# EAGLE schematic Resistor_Resistor (EAGLE 8.3.0), part 2 of 43
## Parts (continued)
R1479  10K  RESISTOR_0201  [0201]
R1480  10K  RESISTOR_0201  [0201]
R1481  10K  RESISTOR_0201  [0201]
R1482  10K  RESISTOR_0201  [0201]
R1483  10K  RESISTOR_0201  [0201]
R1484  10K  RESISTOR_0201  [0201]
R1485  10K  RESISTOR_0201  [0201]
R1486  10K  RESISTOR_0201  [0201]
R1487  10K  RESISTOR_0201  [0201]
R1488  10K  RESISTOR_0201  [0201]
R1489  10K  RESISTOR_0201  [0201]
R1490  10K  RESISTOR_0201  [0201]
R1491  10K  RESISTOR_0201  [0201]
R1492  10K  RESISTOR_0201  [0201]
R1493  10K  RESISTOR_0201  [0201]
R1494  10K  RESISTOR_0201  [0201]
R1495  10K  RESISTOR_0201  [0201]
R1496  10K  RESISTOR_0201  [0201]
R1497  10K  RESISTOR_0201  [0201]
R1498  10K  RESISTOR_0201  [0201]
R1499  10K  RESISTOR_0201  [0201]
R1500  10K  RESISTOR_0201  [0201]
R1501  10K  RESISTOR_0201  [0201]
R1502  10K  RESISTOR_0201  [0201]
R1503  10K  RESISTOR_0201  [0201]
R1504  10K  RESISTOR_0201  [0201]
R1505  10K  RESISTOR_0201  [0201]
R1506  10K  RESISTOR_0201  [0201]
R1507  10K  RESISTOR_0201  [0201]
R1508  10K  RESISTOR_0201  [0201]
R1509  10K  RESISTOR_0201  [0201]
R1510  10K  RESISTOR_0201  [0201]
R1511  10K  RESISTOR_0201  [0201]
R1512  10K  RESISTOR_0201  [0201]
R1513  10K  RESISTOR_0201  [0201]
R1514  10K  RESISTOR_0201  [0201]
R1515  10K  RESISTOR_0201  [0201]
R1516  10K  RESISTOR_0201  [0201]
R1517  10K  RESISTOR_0201  [0201]
R1518  10K  RESISTOR_0201  [0201]
R1519  10K  RESISTOR_0201  [0201]
R1520  10K  RESISTOR_0201  [0201]
R1521  10K  RESISTOR_0201  [0201]
R1522  10K  RESISTOR_0201  [0201]
R1523  10K  RESISTOR_0201  [0201]
R1524  10K  RESISTOR_0201  [0201]
R1525  10K  RESISTOR_0201  [0201]
R1526  10K  RESISTOR_0201  [0201]
R1527  10K  RESISTOR_0201  [0201]
R1528  10K  RESISTOR_0201  [0201]
R1529  10K  RESISTOR_0201  [0201]
R1530  10K  RESISTOR_0201  [0201]
R1531  10K  RESISTOR_0201  [0201]
R1532  10K  RESISTOR_0201  [0201]
R1533  10K  RESISTOR_0201  [0201]
R1534  10K  RESISTOR_0201  [0201]
R1535  10K  RESISTOR_0201  [0201]
R1536  10K  RESISTOR_0201  [0201]
R1537  10K  RESISTOR_0201  [0201]
R1538  10K  RESISTOR_0201  [0201]
R1539  10K  RESISTOR_0201  [0201]
R1540  10K  RESISTOR_0201  [0201]
R1541  10K  RESISTOR_0201  [0201]
R1542  10K  RESISTOR_0201  [0201]
R1543  10K  RESISTOR_0201  [0201]
R1544  10K  RESISTOR_0201  [0201]
R1545  10K  RESISTOR_0201  [0201]
R1546  10K  RESISTOR_0201  [0201]
R1547  10K  RESISTOR_0201  [0201]
R1548  10K  RESISTOR_0201  [0201]
R1549  10K  RESISTOR_0201  [0201]
R1550  10K  RESISTOR_0201  [0201]
R1551  10K  RESISTOR_0201  [0201]
R1552  10K  RESISTOR_0201  [0201]
R1553  10K  RESISTOR_0201  [0201]
R1554  10K  RESISTOR_0201  [0201]
R1555  10K  RESISTOR_0201  [0201]
R1556  10K  RESISTOR_0201  [0201]
R1557  10K  RESISTOR_0201  [0201]
R1558  10K  RESISTOR_0201  [0201]
R1559  10K  RESISTOR_0201  [0201]
R1560  10K  RESISTOR_0201  [0201]
R1561  10K  RESISTOR_0201  [0201]
R1562  10K  RESISTOR_0201  [0201]
R1563  10K  RESISTOR_0201  [0201]
R1564  10K  RESISTOR_0201  [0201]
R1565  10K  RESISTOR_0201  [0201]
R1566  10K  RESISTOR_0201  [0201]
R1567  10K  RESISTOR_0201  [0201]
R1568  10K  RESISTOR_0201  [0201]
R1569  10K  RESISTOR_0201  [0201]
R1570  10K  RESISTOR_0201  [0201]
R1571  10K  RESISTOR_0201  [0201]
R1572  10K  RESISTOR_0201  [0201]
R1573  10K  RESISTOR_0201  [0201]
R1574  10K  RESISTOR_0201  [0201]
R1575  10K  RESISTOR_0201  [0201]
R1576  10K  RESISTOR_0201  [0201]
R1577  10K  RESISTOR_0201  [0201]
R1578  10K  RESISTOR_0201  [0201]
R1579  10K  RESISTOR_0201  [0201]
R1580  10K  RESISTOR_0201  [0201]
R1581  10K  RESISTOR_0201  [0201]
R1582  10K  RESISTOR_0201  [0201]
R1583  10K  RESISTOR_0201  [0201]
R1584  10K  RESISTOR_0201  [0201]
R1585  10K  RESISTOR_0201  [0201]
R1586  10K  RESISTOR_0201  [0201]
R1587  10K  RESISTOR_0201  [0201]
R1588  10K  RESISTOR_0201  [0201]
R1589  10K  RESISTOR_0201  [0201]
R1590  10K  RESISTOR_0201  [0201]
R1591  10K  RESISTOR_0201  [0201]
R1592  10K  RESISTOR_0201  [0201]
R1593  10K  RESISTOR_0201  [0201]
R1594  10K  RESISTOR_0201  [0201]
R1595  10K  RESISTOR_0201  [0201]
R1596  10K  RESISTOR_0201  [0201]
R1597  10K  RESISTOR_0201  [0201]
R1598  10K  RESISTOR_0201  [0201]
R1599  10K  RESISTOR_0201  [0201]
R1600  10K  RESISTOR_0201  [0201]
R1601  10K  RESISTOR_0201  [0201]
R1602  10K  RESISTOR_0201  [0201]
R1603  10K  RESISTOR_0201  [0201]
R1604  10K  RESISTOR_0201  [0201]
R1605  10K  RESISTOR_0201  [0201]
R1606  10K  RESISTOR_0201  [0201]
R1607  10K  RESISTOR_0201  [0201]
R1608  10K  RESISTOR_0201  [0201]
R1609  10K  RESISTOR_0201  [0201]
R1610  10K  RESISTOR_0201  [0201]
R1611  10K  RESISTOR_0201  [0201]
R1612  10K  RESISTOR_0201  [0201]
R1613  10K  RESISTOR_0201  [0201]
R1614  10K  RESISTOR_0201  [0201]
R1615  10K  RESISTOR_0201  [0201]
R1616  10K  RESISTOR_0201  [0201]
R1617  10K  RESISTOR_0201  [0201]
R1618  10K  RESISTOR_0201  [0201]
R1619  10K  RESISTOR_0201  [0201]
R1620  10K  RESISTOR_0201  [0201]
R1621  10K  RESISTOR_0201  [0201]
R1622  10K  RESISTOR_0201  [0201]
R1623  10K  RESISTOR_0201  [0201]
R1624  10K  RESISTOR_0201  [0201]
R1625  10K  RESISTOR_0201  [0201]
R1626  10K  RESISTOR_0201  [0201]
R1627  10K  RESISTOR_0201  [0201]
R1628  10K  RESISTOR_0201  [0201]
R1629  10K  RESISTOR_0201  [0201]
R1630  10K  RESISTOR_0201  [0201]
R1631  10K  RESISTOR_0201  [0201]
R1632  10K  RESISTOR_0201  [0201]
R1633  10K  RESISTOR_0201  [0201]
R1634  10K  RESISTOR_0201  [0201]
R1635  10K  RESISTOR_0201  [0201]
R1636  10K  RESISTOR_0201  [0201]
R1637  10K  RESISTOR_0201  [0201]
R1638  10K  RESISTOR_0201  [0201]
R1639  10K  RESISTOR_0201  [0201]
R1640  10K  RESISTOR_0201  [0201]
R1641  10K  RESISTOR_0201  [0201]
R1642  10K  RESISTOR_0201  [0201]
R1643  10K  RESISTOR_0201  [0201]
R1644  10K  RESISTOR_0201  [0201]
R1645  10K  RESISTOR_0201  [0201]
R1646  10K  RESISTOR_0201  [0201]
R1647  10K  RESISTOR_0201  [0201]
R1648  10K  RESISTOR_0201  [0201]
R1649  10K  RESISTOR_0201  [0201]
R1650  10K  RESISTOR_0201  [0201]
R1651  10K  RESISTOR_0201  [0201]
R1652  10K  RESISTOR_0201  [0201]
R1653  10K  RESISTOR_0201  [0201]
R1654  10K  RESISTOR_0201  [0201]
R1655  10K  RESISTOR_0201  [0201]
R1656  10K  RESISTOR_0201  [0201]
R1657  10K  RESISTOR_0201  [0201]
R1658  10K  RESISTOR_0201  [0201]
R1659  10K  RESISTOR_0201  [0201]
R1660  10K  RESISTOR_0201  [0201]
R1661  10K  RESISTOR_0201  [0201]
R1662  10K  RESISTOR_0201  [0201]
R1663  10K  RESISTOR_0201  [0201]
R1664  10K  RESISTOR_0201  [0201]
R1665  10K  RESISTOR_0201  [0201]
R1666  10K  RESISTOR_0201  [0201]
R1667  10K  RESISTOR_0201  [0201]
R1668  10K  RESISTOR_0201  [0201]
R1669  10K  RESISTOR_0201  [0201]
R1670  10K  RESISTOR_0201  [0201]
R1671  10K  RESISTOR_0201  [0201]
R1672  10K  RESISTOR_0201  [0201]
R1673  10K  RESISTOR_0201  [0201]
R1674  10K  RESISTOR_0201  [0201]
R1675  10K  RESISTOR_0201  [0201]
R1676  10K  RESISTOR_0201  [0201]
R1677  10K  RESISTOR_0201  [0201]
R1678  10K  RESISTOR_0201  [0201]
R1679  10K  RESISTOR_0201  [0201]
R1680  10K  RESISTOR_0201  [0201]
R1681  10K  RESISTOR_0201  [0201]
R1682  10K  RESISTOR_0201  [0201]
R1683  10K  RESISTOR_0201  [0201]
R1684  10K  RESISTOR_0201  [0201]
R1685  10K  RESISTOR_0201  [0201]
R1686  10K  RESISTOR_0201  [0201]
R1687  10K  RESISTOR_0201  [0201]
R1688  10K  RESISTOR_0201  [0201]
R1689  10K  RESISTOR_0201  [0201]
R1690  10K  RESISTOR_0201  [0201]
R1691  10K  RESISTOR_0201  [0201]
R1692  10K  RESISTOR_0201  [0201]
R1693  10K  RESISTOR_0201  [0201]
R1694  10K  RESISTOR_0201  [0201]
R1695  10K  RESISTOR_0201  [0201]
R1696  10K  RESISTOR_0201  [0201]
R1697  10K  RESISTOR_0201  [0201]
R1698  10K  RESISTOR_0201  [0201]
R1699  10K  RESISTOR_0201  [0201]
R1700  10K  RESISTOR_0201  [0201]
R1701  10K  RESISTOR_0201  [0201]
R1702  10K  RESISTOR_0201  [0201]
R1703  10K  RESISTOR_0201  [0201]
R1704  10K  RESISTOR_0201  [0201]
R1705  10K  RESISTOR_0201  [0201]
R1706  10K  RESISTOR_0201  [0201]
R1707  10K  RESISTOR_0201  [0201]
R1708  10K  RESISTOR_0201  [0201]
R1709  10K  RESISTOR_0201  [0201]
R1710  10K  RESISTOR_0201  [0201]
R1711  10K  RESISTOR_0201  [0201]
R1712  10K  RESISTOR_0201  [0201]
R1713  10K  RESISTOR_0201  [0201]
R1714  10K  RESISTOR_0201  [0201]
R1715  10K  RESISTOR_0201  [0201]
R1716  10K  RESISTOR_0201  [0201]
R1717  10K  RESISTOR_0201  [0201]
R1718  10K  RESISTOR_0201  [0201]
R1719  10K  RESISTOR_0201  [0201]
R1720  10K  RESISTOR_0201  [0201]
R1721  10K  RESISTOR_0201  [0201]
R1722  10K  RESISTOR_0201  [0201]
R1723  10K  RESISTOR_0201  [0201]
R1724  10K  RESISTOR_0201  [0201]
R1725  10K  RESISTOR_0201  [0201]
R1726  10K  RESISTOR_0201  [0201]
R1727  10K  RESISTOR_0201  [0201]
R1728  10K  RESISTOR_0201  [0201]
R1729  10K  RESISTOR_0201  [0201]
R1730  10K  RESISTOR_0201  [0201]
R1731  10K  RESISTOR_0201  [0201]
R1732  10K  RESISTOR_0201  [0201]
R1733  10K  RESISTOR_0201  [0201]
R1734  10K  RESISTOR_0201  [0201]
R1735  10K  RESISTOR_0201  [0201]
R1736  10K  RESISTOR_0201  [0201]
R1737  10K  RESISTOR_0201  [0201]
R1738  10K  RESISTOR_0201  [0201]
R1739  10K  RESISTOR_0201  [0201]
R1740  10K  RESISTOR_0201  [0201]
R1741  10K  RESISTOR_0201  [0201]
R1742  10K  RESISTOR_0201  [0201]
R1743  10K  RESISTOR_0201  [0201]
R1744  10K  RESISTOR_0201  [0201]
R1745  10K  RESISTOR_0201  [0201]
R1746  10K  RESISTOR_0201  [0201]
R1747  10K  RESISTOR_0201  [0201]
R1748  10K  RESISTOR_0201  [0201]
R1749  10K  RESISTOR_0201  [0201]
R1750  10K  RESISTOR_0201  [0201]
R1751  10K  RESISTOR_0201  [0201]
R1752  10K  RESISTOR_0201  [0201]
R1753  10K  RESISTOR_0201  [0201]
R1754  10K  RESISTOR_0201  [0201]
R1755  10K  RESISTOR_0201  [0201]
R1756  10K  RESISTOR_0201  [0201]
R1757  10K  RESISTOR_0201  [0201]
R1758  10K  RESISTOR_0201  [0201]
R1759  10K  RESISTOR_0201  [0201]
R1760  10K  RESISTOR_0201  [0201]
R1761  10K  RESISTOR_0201  [0201]
R1762  10K  RESISTOR_0201  [0201]
R1763  10K  RESISTOR_0201  [0201]
R1764  10K  RESISTOR_0201  [0201]
R1765  10K  RESISTOR_0201  [0201]
R1766  10K  RESISTOR_0201  [0201]
R1767  10K  RESISTOR_0201  [0201]
R1768  10K  RESISTOR_0201  [0201]
R1769  10K  RESISTOR_0201  [0201]
R1770  10K  RESISTOR_0201  [0201]
R1771  10K  RESISTOR_0201  [0201]
R1772  10K  RESISTOR_0201  [0201]
R1773  10K  RESISTOR_0201  [0201]
R1774  10K  RESISTOR_0201  [0201]
R1775  10K  RESISTOR_0201  [0201]
R1776  10K  RESISTOR_0201  [0201]
R1777  10K  RESISTOR_0201  [0201]
R1778  10K  RESISTOR_0201  [0201]
R1779  10K  RESISTOR_0201  [0201]
R1780  10K  RESISTOR_0201  [0201]
R1781  10K  RESISTOR_0201  [0201]
R1782  10K  RESISTOR_0201  [0201]
R1783  10K  RESISTOR_0201  [0201]
R1784  10K  RESISTOR_0201  [0201]
R1785  10K  RESISTOR_0201  [0201]
R1786  10K  RESISTOR_0201  [0201]
R1787  10K  RESISTOR_0201  [0201]
R1788  10K  RESISTOR_0201  [0201]
R1789  10K  RESISTOR_0201  [0201]
R1790  10K  RESISTOR_0201  [0201]
R1791  10K  RESISTOR_0201  [0201]
R1792  10K  RESISTOR_0201  [0201]
R1793  10K  RESISTOR_0201  [0201]
R1794  10K  RESISTOR_0201  [0201]
R1795  10K  RESISTOR_0201  [0201]
R1796  10K  RESISTOR_0201  [0201]
R1797  10K  RESISTOR_0201  [0201]
R1798  10K  RESISTOR_0201  [0201]
R1799  10K  RESISTOR_0201  [0201]
R1800  10K  RESISTOR_0201  [0201]
R1801  10K  RESISTOR_0201  [0201]
R1802  10K  RESISTOR_0201  [0201]
R1803  10K  RESISTOR_0201  [0201]
R1804  10K  RESISTOR_0201  [0201]
R1805  10K  RESISTOR_0201  [0201]
R1806  10K  RESISTOR_0201  [0201]
R1807  10K  RESISTOR_0201  [0201]
R1808  10K  RESISTOR_0201  [0201]
R1809  10K  RESISTOR_0201  [0201]
R1810  10K  RESISTOR_0201  [0201]
R1811  10K  RESISTOR_0201  [0201]
R1812  10K  RESISTOR_0201  [0201]
R1813  10K  RESISTOR_0201  [0201]
R1814  10K  RESISTOR_0201  [0201]
R1815  10K  RESISTOR_0201  [0201]
R1816  10K  RESISTOR_0201  [0201]
R1817  10K  RESISTOR_0201  [0201]
R1818  10K  RESISTOR_0201  [0201]
R1819  10K  RESISTOR_0201  [0201]
R1820  10K  RESISTOR_0201  [0201]
R1821  10K  RESISTOR_0201  [0201]
R1822  10K  RESISTOR_0201  [0201]
R1823  10K  RESISTOR_0201  [0201]
R1824  10K  RESISTOR_0201  [0201]
R1825  10K  RESISTOR_0201  [0201]
R1826  10K  RESISTOR_0201  [0201]
R1827  10K  RESISTOR_0201  [0201]
R1828  10K  RESISTOR_0201  [0201]
R1829  10K  RESISTOR_0201  [0201]
R1830  10K  RESISTOR_0201  [0201]
R1831  10K  RESISTOR_0201  [0201]
R1832  10K  RESISTOR_0201  [0201]
R1833  10K  RESISTOR_0201  [0201]
R1834  10K  RESISTOR_0201  [0201]
R1835  10K  RESISTOR_0201  [0201]
R1836  10K  RESISTOR_0201  [0201]
R1837  10K  RESISTOR_0201  [0201]
R1838  10K  RESISTOR_0201  [0201]
R1839  10K  RESISTOR_0201  [0201]
R1840  10K  RESISTOR_0201  [0201]
R1841  10K  RESISTOR_0201  [0201]
R1842  10K  RESISTOR_0201  [0201]
R1843  10K  RESISTOR_0201  [0201]
R1844  10K  RESISTOR_0201  [0201]
R1845  10K  RESISTOR_0201  [0201]
R1846  10K  RESISTOR_0201  [0201]
R1847  10K  RESISTOR_0201  [0201]
R1848  10K  RESISTOR_0201  [0201]
R1849  10K  RESISTOR_0201  [0201]
R1850  10K  RESISTOR_0201  [0201]
R1851  10K  RESISTOR_0201  [0201]
R1852  10K  RESISTOR_0201  [0201]
R1853  10K  RESISTOR_0201  [0201]
R1854  10K  RESISTOR_0201  [0201]
R1855  10K  RESISTOR_0201  [0201]
R1856  10K  RESISTOR_0201  [0201]
R1857  10K  RESISTOR_0201  [0201]
R1858  10K  RESISTOR_0201  [0201]
R1859  10K  RESISTOR_0201  [0201]
R1860  10K  RESISTOR_0201  [0201]
R1861  10K  RESISTOR_0201  [0201]
R1862  10K  RESISTOR_0201  [0201]
R1863  10K  RESISTOR_0201  [0201]
R1864  10K  RESISTOR_0201  [0201]
R1865  10K  RESISTOR_0201  [0201]
R1866  10K  RESISTOR_0201  [0201]
R1867  10K  RESISTOR_0201  [0201]
R1868  10K  RESISTOR_0201  [0201]
R1869  10K  RESISTOR_0201  [0201]
R1870  10K  RESISTOR_0201  [0201]
R1871  10K  RESISTOR_0201  [0201]
R1872  10K  RESISTOR_0201  [0201]
R1873  10K  RESISTOR_0201  [0201]
R1874  10K  RESISTOR_0201  [0201]
R1875  10K  RESISTOR_0201  [0201]
R1876  10K  RESISTOR_0201  [0201]
R1877  10K  RESISTOR_0201  [0201]
R1878  10K  RESISTOR_0201  [0201]
R1879  10K  RESISTOR_0201  [0201]
R1880  10K  RESISTOR_0201  [0201]
R1881  10K  RESISTOR_0201  [0201]
R1882  10K  RESISTOR_0201  [0201]
R1883  10K  RESISTOR_0201  [0201]
R1884  10K  RESISTOR_0201  [0201]
R1885  10K  RESISTOR_0201  [0201]
R1886  10K  RESISTOR_0201  [0201]
R1887  10K  RESISTOR_0201  [0201]
R1888  10K  RESISTOR_0201  [0201]
R1889  10K  RESISTOR_0201  [0201]
R1890  10K  RESISTOR_0201  [0201]
R1891  10K  RESISTOR_0201  [0201]
R1892  10K  RESISTOR_0201  [0201]
R1893  10K  RESISTOR_0201  [0201]
R1894  10K  RESISTOR_0201  [0201]
R1895  10K  RESISTOR_0201  [0201]
R1896  10K  RESISTOR_0201  [0201]
R1897  10K  RESISTOR_0201  [0201]
R1898  10K  RESISTOR_0201  [0201]
R1899  10K  RESISTOR_0201  [0201]
R1900  10K  RESISTOR_0201  [0201]
R1901  10K  RESISTOR_0201  [0201]
R1902  10K  RESISTOR_0201  [0201]
R1903  10K  RESISTOR_0201  [0201]
R1904  10K  RESISTOR_0201  [0201]
R1905  10K  RESISTOR_0201  [0201]
R1906  10K  RESISTOR_0201  [0201]
R1907  10K  RESISTOR_0201  [0201]
R1908  10K  RESISTOR_0201  [0201]
R1909  10K  RESISTOR_0201  [0201]
R1910  10K  RESISTOR_0201  [0201]
R1911  10K  RESISTOR_0201  [0201]
R1912  10K  RESISTOR_0201  [0201]
R1913  10K  RESISTOR_0201  [0201]
R1914  10K  RESISTOR_0201  [0201]
R1915  10K  RESISTOR_0201  [0201]
R1916  10K  RESISTOR_0201  [0201]
R1917  10K  RESISTOR_0201  [0201]
R1918  10K  RESISTOR_0201  [0201]
R1919  10K  RESISTOR_0201  [0201]
R1920  10K  RESISTOR_0201  [0201]
R1921  10K  RESISTOR_0201  [0201]
R1922  10K  RESISTOR_0201  [0201]
R1923  10K  RESISTOR_0201  [0201]
R1924  10K  RESISTOR_0201  [0201]
R1925  10K  RESISTOR_0201  [0201]
R1926  10K  RESISTOR_0201  [0201]
R1927  10K  RESISTOR_0201  [0201]
R1928  10K  RESISTOR_0201  [0201]
R1929  10K  RESISTOR_0201  [0201]
R1930  10K  RESISTOR_0201  [0201]
R1931  10K  RESISTOR_0201  [0201]
R1932  10K  RESISTOR_0201  [0201]
R1933  10K  RESISTOR_0201  [0201]
R1934  10K  RESISTOR_0201  [0201]
R1935  10K  RESISTOR_0201  [0201]
R1936  10K  RESISTOR_0201  [0201]
R1937  10K  RESISTOR_0201  [0201]
R1938  10K  RESISTOR_0201  [0201]
R1939  10K  RESISTOR_0201  [0201]
R1940  10K  RESISTOR_0201  [0201]
R1941  10K  RESISTOR_0201  [0201]
R1942  10K  RESISTOR_0201  [0201]
R1943  10K  RESISTOR_0201  [0201]
R1944  10K  RESISTOR_0201  [0201]
R1945  10K  RESISTOR_0201  [0201]
R1946  10K  RESISTOR_0201  [0201]
R1947  10K  RESISTOR_0201  [0201]
R1948  10K  RESISTOR_0201  [0201]
R1949  10K  RESISTOR_0201  [0201]
R1950  10K  RESISTOR_0201  [0201]
R1951  10K  RESISTOR_0201  [0201]
R1952  10K  RESISTOR_0201  [0201]
R1953  10K  RESISTOR_0201  [0201]
R1954  10K  RESISTOR_0201  [0201]
R1955  10K  RESISTOR_0201  [0201]
R1956  10K  RESISTOR_0201  [0201]
R1957  10K  RESISTOR_0201  [0201]
R1958  10K  RESISTOR_0201  [0201]
R1959  10K  RESISTOR_0201  [0201]
R1960  10K  RESISTOR_0201  [0201]
R1961  10K  RESISTOR_0201  [0201]
R1962  10K  RESISTOR_0201  [0201]
R1963  10K  RESISTOR_0201  [0201]
R1964  10K  RESISTOR_0201  [0201]
R1965  10K  RESISTOR_0201  [0201]
R1966  10K  RESISTOR_0201  [0201]
R1967  10K  RESISTOR_0201  [0201]
R1968  10K  RESISTOR_0201  [0201]
R1969  10K  RESISTOR_0201  [0201]
R1970  10K  RESISTOR_0201  [0201]
R1971  10K  RESISTOR_0201  [0201]
R1972  10K  RESISTOR_0201  [0201]
R1973  10K  RESISTOR_0201  [0201]
R1974  10K  RESISTOR_0201  [0201]
R1975  10K  RESISTOR_0201  [0201]
R1976  10K  RESISTOR_0201  [0201]
R1977  10K  RESISTOR_0201  [0201]
R1978  10K  RESISTOR_0201  [0201]
R1979  10K  RESISTOR_0201  [0201]
R1980  10K  RESISTOR_0201  [0201]
R1981  10K  RESISTOR_0201  [0201]
R1982  10K  RESISTOR_0201  [0201]
R1983  10K  RESISTOR_0201  [0201]
R1984  10K  RESISTOR_0201  [0201]
R1985  10K  RESISTOR_0201  [0201]
R1986  10K  RESISTOR_0201  [0201]
R1987  10K  RESISTOR_0201  [0201]
R1988  10K  RESISTOR_0201  [0201]
R1989  10K  RESISTOR_0201  [0201]
R1990  10K  RESISTOR_0201  [0201]
R1991  10K  RESISTOR_0201  [0201]
R1992  10K  RESISTOR_0201  [0201]
R1993  10K  RESISTOR_0201  [0201]
R1994  10K  RESISTOR_0201  [0201]
R1995  10K  RESISTOR_0201  [0201]
R1996  10K  RESISTOR_0201  [0201]
R1997  10K  RESISTOR_0201  [0201]
R1998  10K  RESISTOR_0201  [0201]
R1999  10K  RESISTOR_0201  [0201]
R2000  10K  RESISTOR_0201  [0201]
R2001  10K  RESISTOR_0201  [0201]
R2002  10K  RESISTOR_0201  [0201]
R2003  10K  RESISTOR_0201  [0201]
R2004  10K  RESISTOR_0201  [0201]
R2005  10K  RESISTOR_0201  [0201]
R2006  10K  RESISTOR_0201  [0201]
R2007  10K  RESISTOR_0201  [0201]
R2008  10K  RESISTOR_0201  [0201]
R2009  10K  RESISTOR_0201  [0201]
R2010  10K  RESISTOR_0201  [0201]
R2011  10K  RESISTOR_0201  [0201]
R2012  10K  RESISTOR_0201  [0201]
R2013  10K  RESISTOR_0201  [0201]
R2014  10K  RESISTOR_0201  [0201]
R2015  10K  RESISTOR_0201  [0201]
R2016  10K  RESISTOR_0201  [0201]
R2017  10K  RESISTOR_0201  [0201]
R2018  10K  RESISTOR_0201  [0201]
R2019  10K  RESISTOR_0201  [0201]
R2020  10K  RESISTOR_0201  [0201]
R2021  10K  RESISTOR_0201  [0201]
R2022  10K  RESISTOR_0201  [0201]
R2023  10K  RESISTOR_0201  [0201]
R2024  10K  RESISTOR_0201  [0201]
R2025  10K  RESISTOR_0201  [0201]
R2026  10K  RESISTOR_0201  [0201]
R2027  10K  RESISTOR_0201  [0201]
R2028  10K  RESISTOR_0201  [0201]
R2029  10K  RESISTOR_0201  [0201]
R2030  10K  RESISTOR_0201  [0201]
R2031  10K  RESISTOR_0201  [0201]
R2032  10K  RESISTOR_0201  [0201]
R2033  10K  RESISTOR_0201  [0201]
R2034  10K  RESISTOR_0201  [0201]
R2035  10K  RESISTOR_0201  [0201]
R2036  10K  RESISTOR_0201  [0201]
R2037  10K  RESISTOR_0201  [0201]
R2038  10K  RESISTOR_0201  [0201]
R2039  10K  RESISTOR_0201  [0201]
R2040  10K  RESISTOR_0201  [0201]
R2041  10K  RESISTOR_0201  [0201]
R2042  10K  RESISTOR_0201  [0201]
R2043  10K  RESISTOR_0201  [0201]
R2044  10K  RESISTOR_0201  [0201]
R2045  10K  RESISTOR_0201  [0201]
R2046  10K  RESISTOR_0201  [0201]
R2047  10K  RESISTOR_0201  [0201]
R2048  10K  RESISTOR_0201  [0201]
R2049  10K  RESISTOR_0201  [0201]
R2050  10K  RESISTOR_0201  [0201]
R2051  10K  RESISTOR_0201  [0201]
R2052  10K  RESISTOR_0201  [0201]
R2053  10K  RESISTOR_0201  [0201]
R2054  10K  RESISTOR_0201  [0201]
R2055  10K  RESISTOR_0201  [0201]
R2056  10K  RESISTOR_0201  [0201]
R2057  10K  RESISTOR_0201  [0201]
R2058  10K  RESISTOR_0201  [0201]
R2059  10K  RESISTOR_0201  [0201]
R2060  10K  RESISTOR_0201  [0201]
R2061  10K  RESISTOR_0201  [0201]
R2062  10K  RESISTOR_0201  [0201]
R2063  10K  RESISTOR_0201  [0201]
R2064  10K  RESISTOR_0201  [0201]
R2065  10K  RESISTOR_0201  [0201]
R2066  10K  RESISTOR_0201  [0201]
R2067  10K  RESISTOR_0201  [0201]
R2068  10K  RESISTOR_0201  [0201]
R2069  10K  RESISTOR_0201  [0201]
R2070  10K  RESISTOR_0201  [0201]
R2071  10K  RESISTOR_0201  [0201]
R2072  10K  RESISTOR_0201  [0201]
R2073  10K  RESISTOR_0201  [0201]
R2074  10K  RESISTOR_0201  [0201]
R2075  10K  RESISTOR_0201  [0201]
R2076  10K  RESISTOR_0201  [0201]
R2077  10K  RESISTOR_0201  [0201]
R2078  10K  RESISTOR_0201  [0201]
R2079  10K  RESISTOR_0201  [0201]
R2080  10K  RESISTOR_0201  [0201]
R2081  10K  RESISTOR_0201  [0201]
R2082  10K  RESISTOR_0201  [0201]
R2083  10K  RESISTOR_0201  [0201]
R2084  10K  RESISTOR_0201  [0201]
R2085  10K  RESISTOR_0201  [0201]
R2086  10K  RESISTOR_0201  [0201]
R2087  10K  RESISTOR_0201  [0201]
R2088  10K  RESISTOR_0201  [0201]
R2089  10K  RESISTOR_0201  [0201]
R2090  10K  RESISTOR_0201  [0201]
R2091  10K  RESISTOR_0201  [0201]
R2092  10K  RESISTOR_0201  [0201]
R2093  10K  RESISTOR_0201  [0201]
R2094  10K  RESISTOR_0201  [0201]
R2095  10K  RESISTOR_0201  [0201]
R2096  10K  RESISTOR_0201  [0201]
R2097  10K  RESISTOR_0201  [0201]
R2098  10K  RESISTOR_0201  [0201]
R2099  10K  RESISTOR_0201  [0201]
R2100  10K  RESISTOR_0201  [0201]
R2101  10K  RESISTOR_0201  [0201]
R2102  10K  RESISTOR_0201  [0201]
R2103  10K  RESISTOR_0201  [0201]
R2104  10K  RESISTOR_0201  [0201]
R2105  10K  RESISTOR_0201  [0201]
R2106  10K  RESISTOR_0201  [0201]
R2107  10K  RESISTOR_0201  [0201]
R2108  10K  RESISTOR_0201  [0201]
R2109  10K  RESISTOR_0201  [0201]
R2110  10K  RESISTOR_0201  [0201]
R2111  10K  RESISTOR_0201  [0201]
R2112  10K  RESISTOR_0201  [0201]
R2113  10K  RESISTOR_0201  [0201]
R2114  10K  RESISTOR_0201  [0201]
R2115  10K  RESISTOR_0201  [0201]
R2116  10K  RESISTOR_0201  [0201]
R2117  10K  RESISTOR_0201  [0201]
R2118  10K  RESISTOR_0201  [0201]
R2119  10K  RESISTOR_0201  [0201]
R2120  10K  RESISTOR_0201  [0201]
R2121  10K  RESISTOR_0201  [0201]
R2122  10K  RESISTOR_0201  [0201]
R2123  10K  RESISTOR_0201  [0201]
R2124  10K  RESISTOR_0201  [0201]
R2125  10K  RESISTOR_0201  [0201]
R2126  10K  RESISTOR_0201  [0201]
R2127  10K  RESISTOR_0201  [0201]
R2128  10K  RESISTOR_0201  [0201]
R2129  10K  RESISTOR_0201  [0201]
R2130  10K  RESISTOR_0201  [0201]
R2131  10K  RESISTOR_0201  [0201]
R2132  10K  RESISTOR_0201  [0201]
R2133  10K  RESISTOR_0201  [0201]
R2134  10K  RESISTOR_0201  [0201]
R2135  10K  RESISTOR_0201  [0201]
R2136  10K  RESISTOR_0201  [0201]
R2137  10K  RESISTOR_0201  [0201]
R2138  10K  RESISTOR_0201  [0201]
R2139  10K  RESISTOR_0201  [0201]
R2140  10K  RESISTOR_0201  [0201]
R2141  10K  RESISTOR_0201  [0201]
R2142  10K  RESISTOR_0201  [0201]
R2143  10K  RESISTOR_0201  [0201]
R2144  10K  RESISTOR_0201  [0201]
R2145  10K  RESISTOR_0201  [0201]
R2146  10K  RESISTOR_0201  [0201]
R2147  10K  RESISTOR_0201  [0201]
R2148  10K  RESISTOR_0201  [0201]
R2149  10K  RESISTOR_0201  [0201]
R2150  10K  RESISTOR_0201  [0201]
R2151  10K  RESISTOR_0201  [0201]
R2152  10K  RESISTOR_0201  [0201]
R2153  10K  RESISTOR_0201  [0201]
R2154  10K  RESISTOR_0201  [0201]
R2155  10K  RESISTOR_0201  [0201]
R2156  10K  RESISTOR_0201  [0201]
R2157  10K  RESISTOR_0201  [0201]
R2158  10K  RESISTOR_0201  [0201]
R2159  10K  RESISTOR_0201  [0201]
R2160  10K  RESISTOR_0201  [0201]
R2161  10K  RESISTOR_0201  [0201]
R2162  10K  RESISTOR_0201  [0201]
R2163  10K  RESISTOR_0201  [0201]
R2164  10K  RESISTOR_0201  [0201]
R2165  10K  RESISTOR_0201  [0201]
R2166  10K  RESISTOR_0201  [0201]
R2167  10K  RESISTOR_0201  [0201]
R2168  10K  RESISTOR_0201  [0201]
R2169  10K  RESISTOR_0201  [0201]
R2170  10K  RESISTOR_0201  [0201]
R2171  10K  RESISTOR_0201  [0201]
R2172  10K  RESISTOR_0201  [0201]
R2173  10K  RESISTOR_0201  [0201]
R2174  10K  RESISTOR_0201  [0201]
R2175  10K  RESISTOR_0201  [0201]
R2176  10K  RESISTOR_0201  [0201]
R2177  10K  RESISTOR_0201  [0201]
R2178  10K  RESISTOR_0201  [0201]
R2179  10K  RESISTOR_0201  [0201]
R2180  10K  RESISTOR_0201  [0201]
R2181  10K  RESISTOR_0201  [0201]
R2182  10K  RESISTOR_0201  [0201]
R2183  10K  RESISTOR_0201  [0201]
R2184  10K  RESISTOR_0201  [0201]
R2185  10K  RESISTOR_0201  [0201]
R2186  10K  RESISTOR_0201  [0201]
R2187  10K  RESISTOR_0201  [0201]
R2188  10K  RESISTOR_0201  [0201]
R2189  10K  RESISTOR_0201  [0201]
R2190  10K  RESISTOR_0201  [0201]
R2191  10K  RESISTOR_0201  [0201]
R2192  10K  RESISTOR_0201  [0201]
R2193  10K  RESISTOR_0201  [0201]
R2194  10K  RESISTOR_0201  [0201]
R2195  10K  RESISTOR_0201  [0201]
R2196  10K  RESISTOR_0201  [0201]
R2197  10K  RESISTOR_0201  [0201]
R2198  10K  RESISTOR_0201  [0201]
R2199  10K  RESISTOR_0201  [0201]
R2200  10K  RESISTOR_0201  [0201]
R2201  10K  RESISTOR_0201  [0201]
R2202  10K  RESISTOR_0201  [0201]
R2203  10K  RESISTOR_0201  [0201]
R2204  10K  RESISTOR_0201  [0201]
R2205  10K  RESISTOR_0201  [0201]
R2206  10K  RESISTOR_0201  [0201]
R2207  10K  RESISTOR_0201  [0201]
R2208  10K  RESISTOR_0201  [0201]